# EasyEDA Pro project M0G3507逐飞主板.eprj, schematic Schematic1

## Sheets
1 主控: Board Name: Board1; Create Date: 2025-07-12; Page Name: 主控; Project Name: M0G3507逐飞主板; Schematic Name: Schematic1; Update Date: 2025-07-24; Company: 嘉立创EDA; Page Size: A4; Version: V1.0
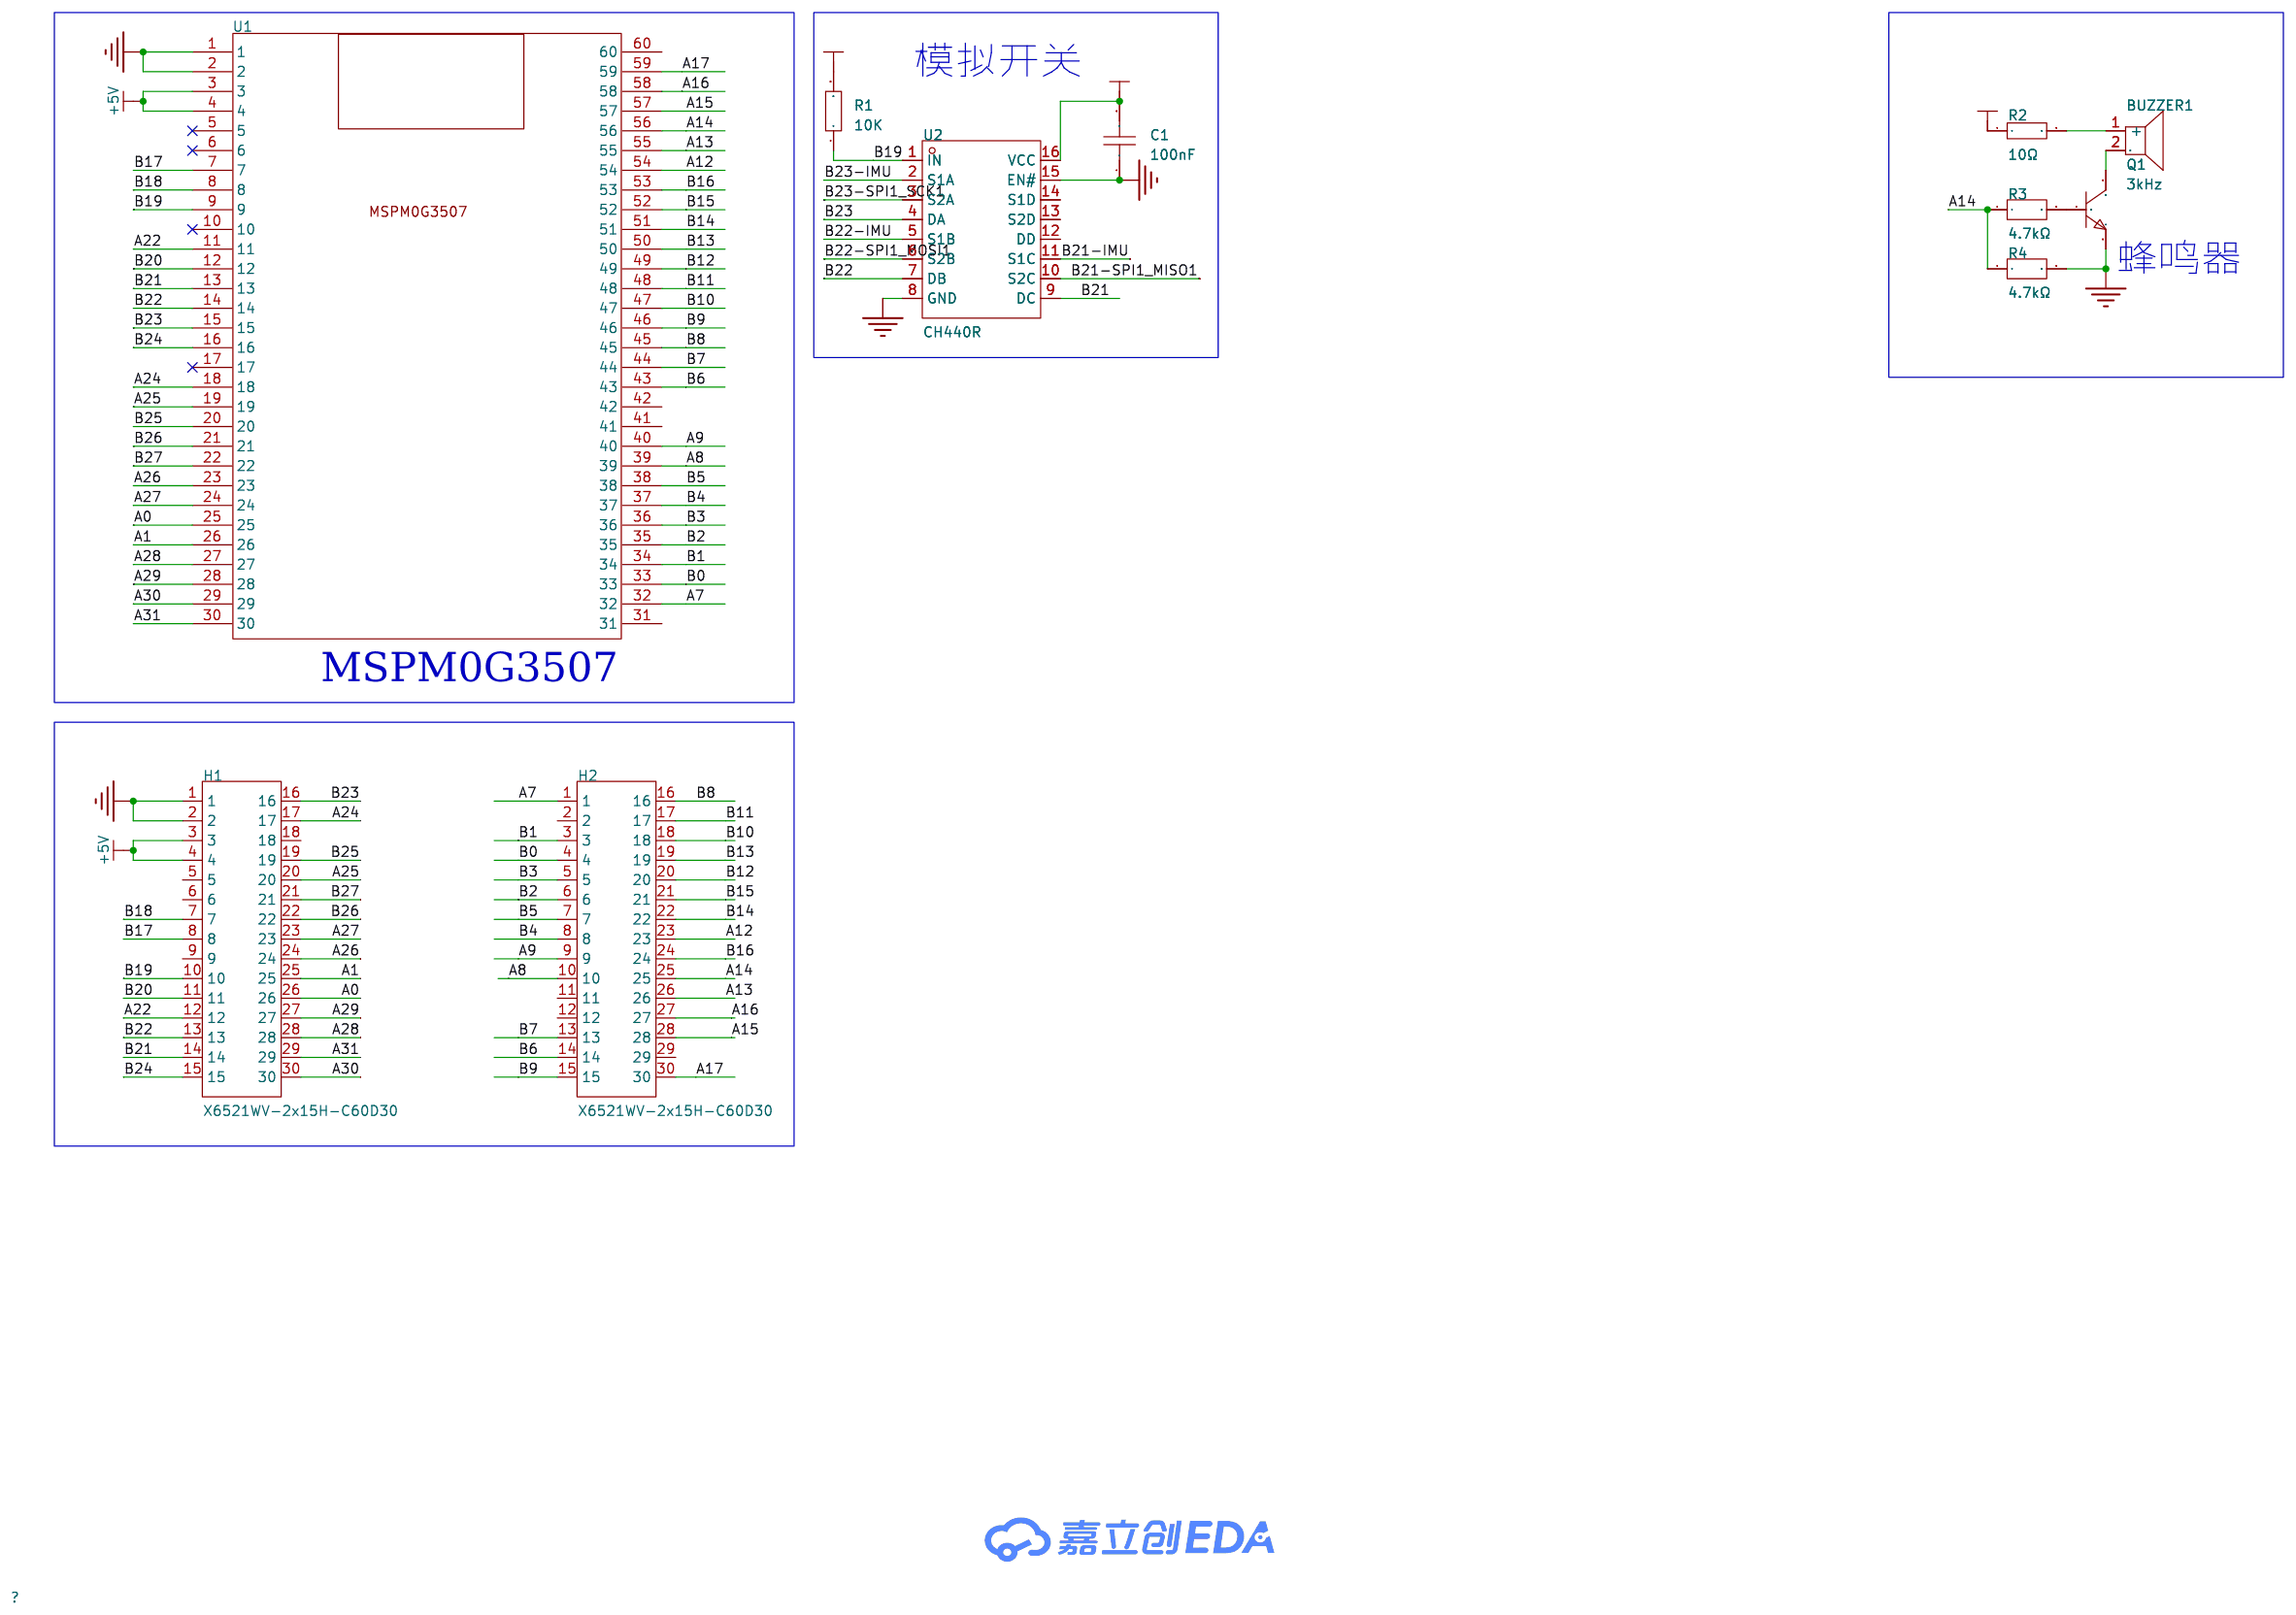
[diagram p0: 主控]
2 电源: Create Date: 2025-07-13; Page Name: 电源
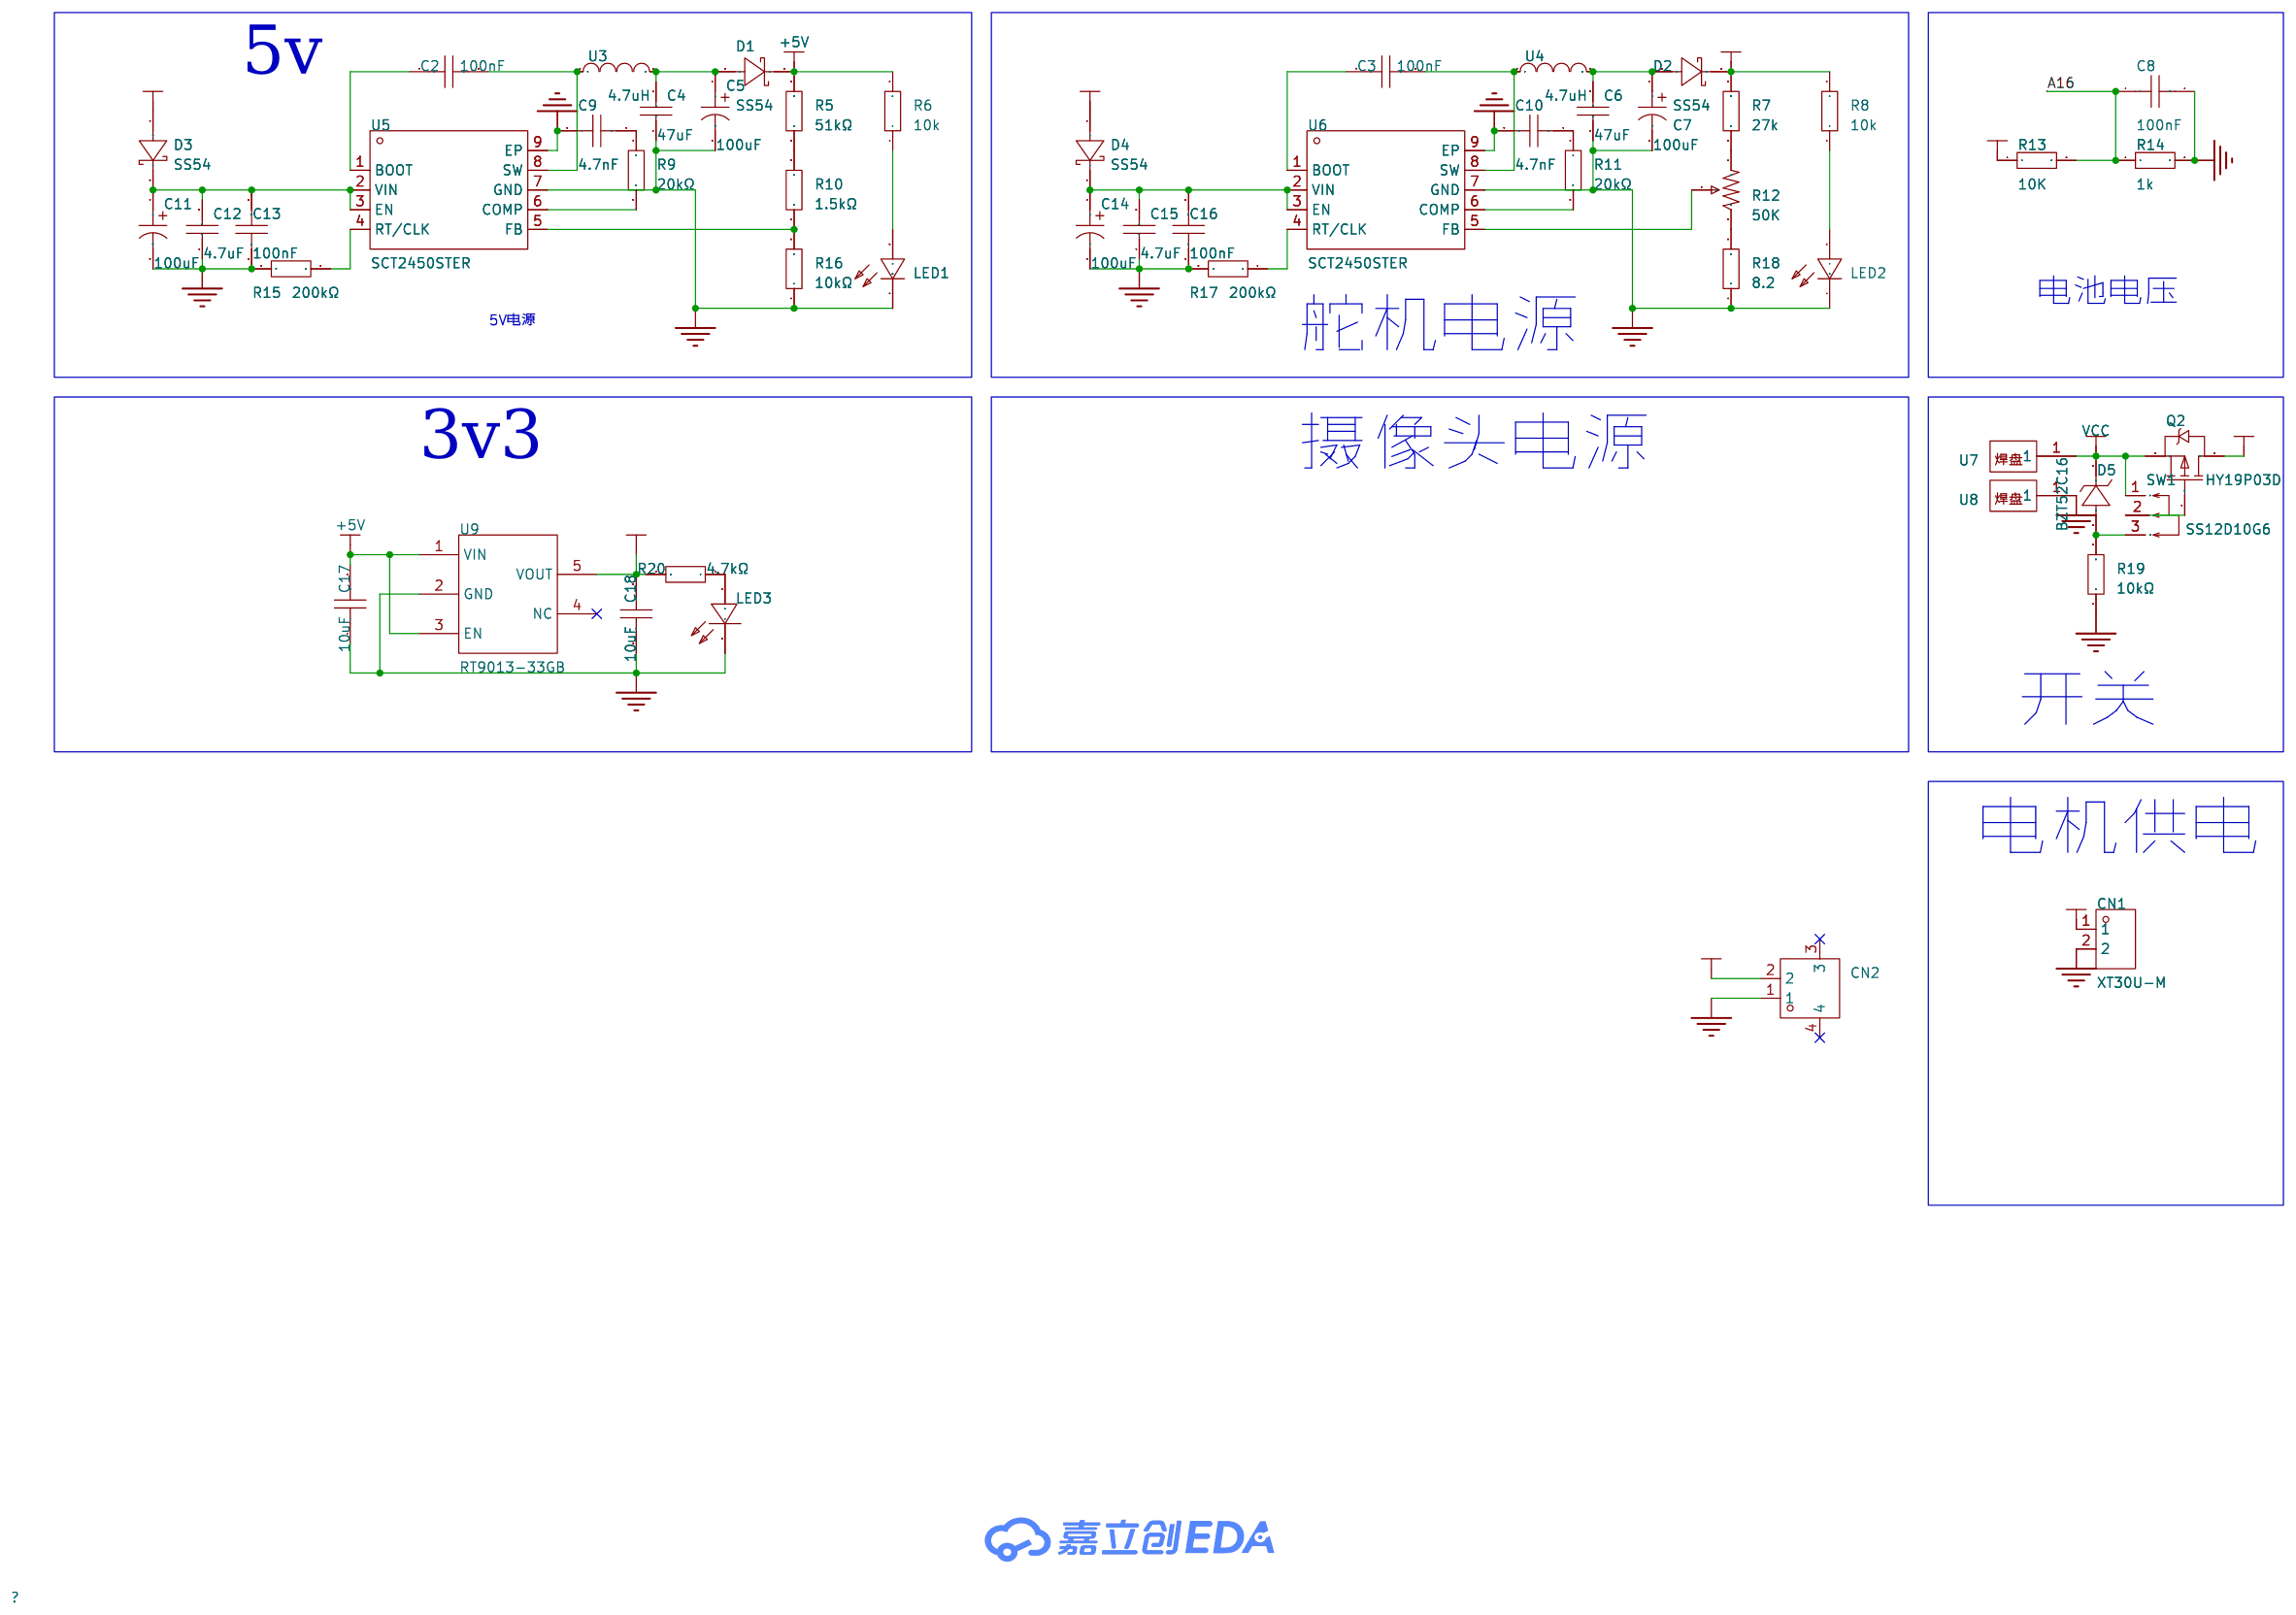
[diagram p1: 电源]
3 外设模块: Create Date: 2025-07-13; Page Name: 外设模块; Update Date: 2025-07-25
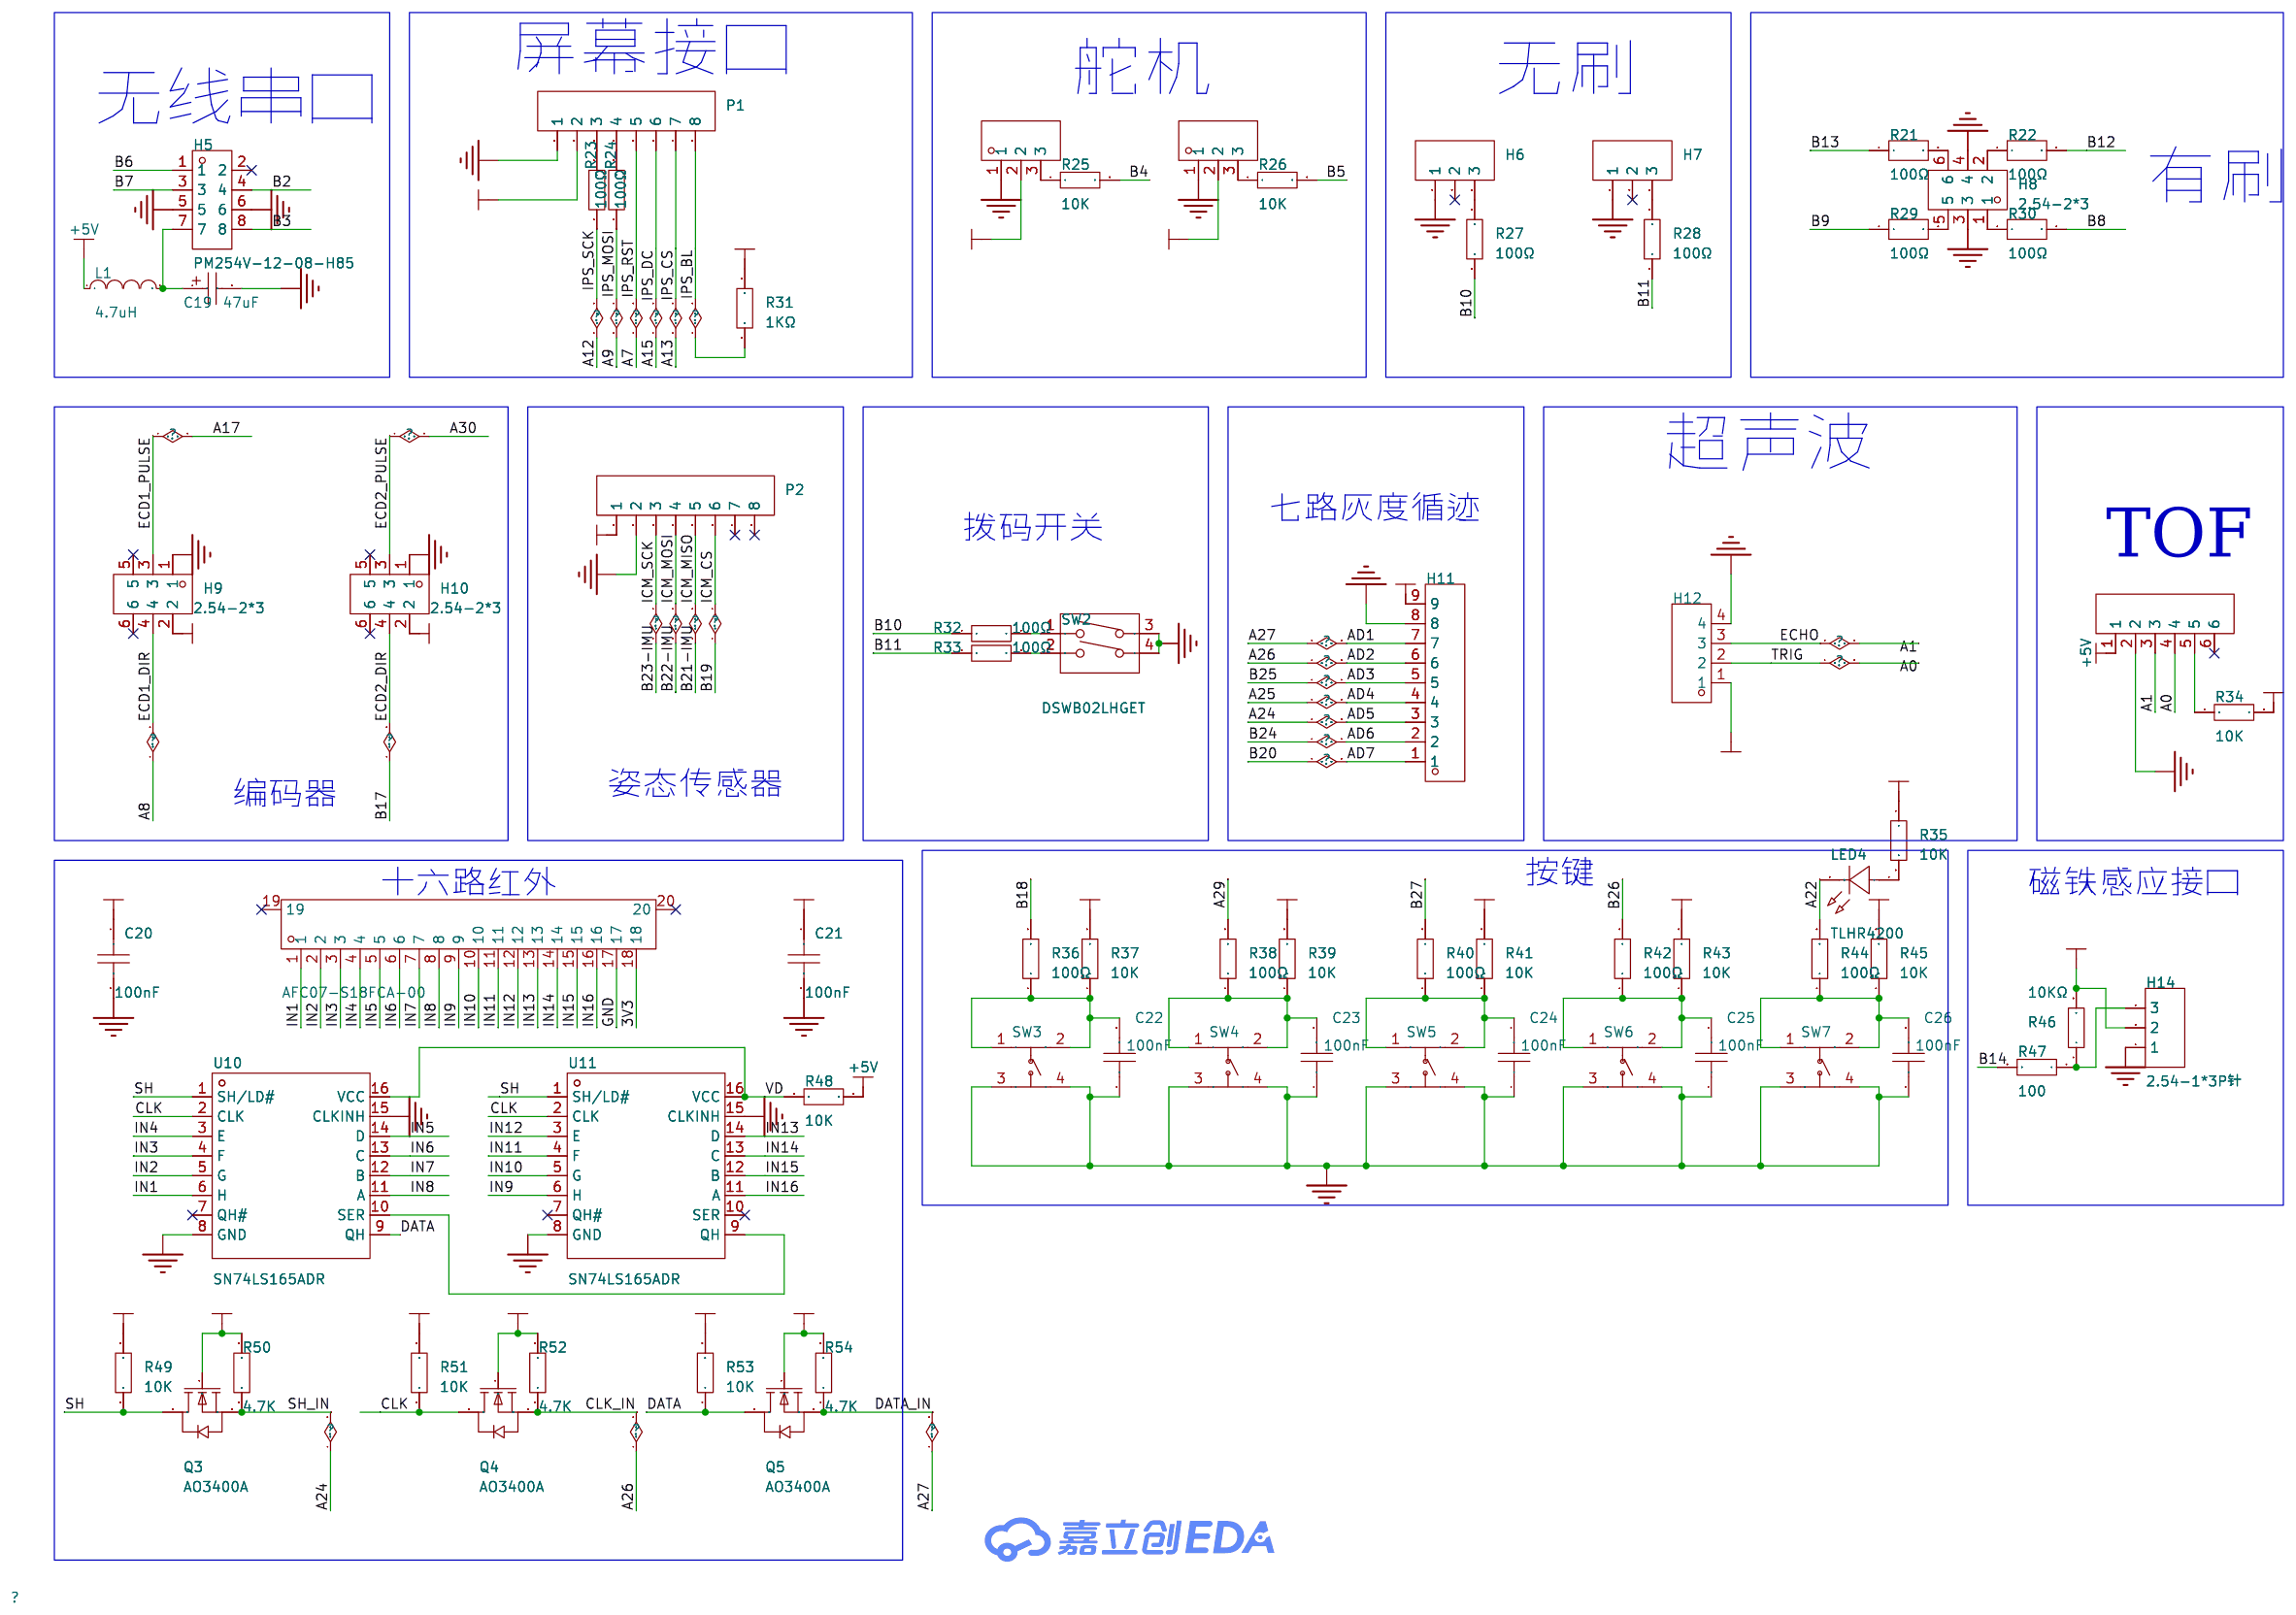
[diagram p2: 外设模块]
4 通信引脚: Create Date: 2025-07-21; Page Name: 通信引脚; Update Date: 2025-07-21
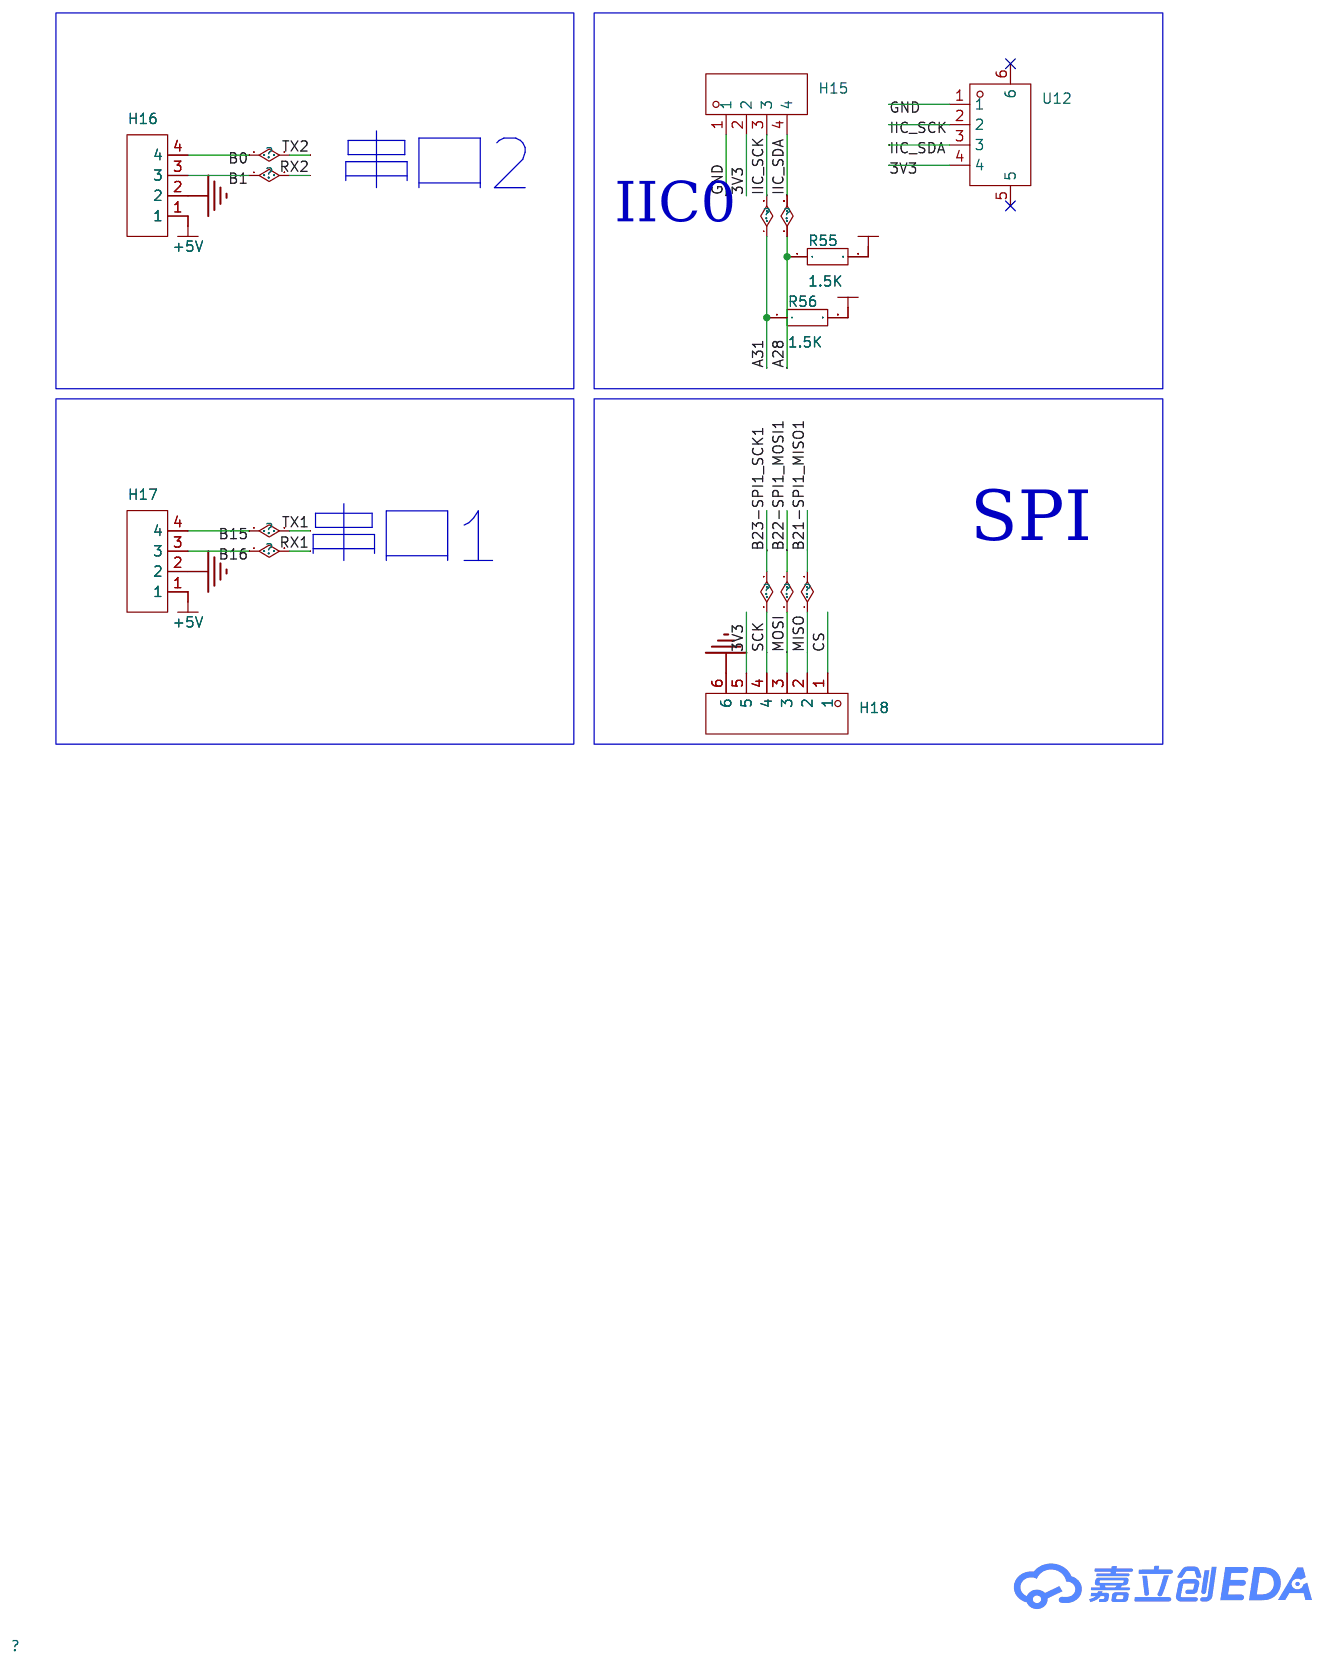
[diagram p3: 通信引脚]

## Parts
sheet 主控
BUZZER1  3kHz  [BUZ-TH_BD9.6-P5.00-D0.7-FD]
C1  100nF  [C0603]
H1  X6521WV-2x15H-C60D30  [HDR-TH_30P-P2.54-V-M-R2-C15-S2.54-BL]
H2  X6521WV-2x15H-C60D30  [HDR-TH_30P-P2.54-V-M-R2-C15-S2.54-BL]
Q1  S8050 J3Y(RANGE:200-350)  [SOT-23-3_L3.0-W1.7-P0.95-LS2.9-BR]
R1  10K  [R0603]
R2  10Ω  [R0603]
R3  4.7kΩ  [R0603]
R4  4.7kΩ  [R0603]
U1  -  [MSPM0G3507]
U2  CH440R  [TSSOP-16_L5.0-W4.4-P0.65-LS6.4-BL]
sheet 外设模块
C19  47uF  [CASE-B_3528]
C20  100nF  [C0402]
C21  100nF  [C0402]
C22  100nF  [C0603]
C23  100nF  [C0603]
C24  100nF  [C0603]
C25  100nF  [C0603]
C26  100nF  [C0603]
H3  -  [HDR-TH_3P-P2.54-V-M]
H4  -  [HDR-TH_3P-P2.54-V-M]
H5  PM254V-12-08-H85  [HDR-TH_8P-P2.54-V-F-R2-C4-S2.54]
H6  2.54-1*3P针  [HDR-TH_3P-P2.54-V-M-1]
H7  2.54-1*3P针  [HDR-TH_3P-P2.54-V-M-1]
H8  2.54-2*3  [HDR-TH_6P-P2.54-V-R2-C3-S2.54_A2541WV-2X3P]
H9  2.54-2*3  [HDR-TH_6P-P2.54-V-R2-C3-S2.54_A2541WV-2X3P]
H10  2.54-2*3  [HDR-TH_6P-P2.54-V-R2-C3-S2.54_A2541WV-2X3P]
H11  HC-PZ254-13.8L-1x9PWA  [HDR-TH_9P-P2.54-H-M-W10.4-N]
H12  -  [HDR-TH_4P-P2.54-V-F]
H13  PZ254V-11-06P  [HDR-TH_6P-P2.54-V-M]
H14  2.54-1*3P针  [HDR-TH_3P-P2.54-V-M-1]
L1  4.7uH  [IND-SMD_L5.4-W5.2_FXL0530]
LED4  TLHR4200  [LED-TH_BD3.2-P2.54-FD]
P1  2.54-1*8P母环保  [HDR-TH_8P-P2.54-V-F-1]
P2  2.54-1*8P母环保  [HDR-TH_8P-P2.54-V-F-1]
Q3  AO3400A  [SOT-23-3_L2.9-W1.3-P1.90-LS2.4-BR]
Q4  AO3400A  [SOT-23-3_L2.9-W1.3-P1.90-LS2.4-BR]
Q5  AO3400A  [SOT-23-3_L2.9-W1.3-P1.90-LS2.4-BR]
R21  100Ω  [R0603]
R22  100Ω  [R0603]
R23  100Ω  [R0603]
R24  100Ω  [R0603]
R25  10K  [R0603]
R26  10K  [R0603]
R27  100Ω  [R0603]
R28  100Ω  [R0603]
R29  100Ω  [R0603]
R30  100Ω  [R0603]
R31  1KΩ  [R0603]
R32  100Ω  [R0603]
R33  100Ω  [R0603]
R34  10K  [R0603]
R35  10K  [R0603]
R36  100Ω  [R0603]
R37  10K  [R0603]
R38  100Ω  [R0603]
R39  10K  [R0603]
R40  100Ω  [R0603]
R41  10K  [R0603]
R42  100Ω  [R0603]
R43  10K  [R0603]
R44  100Ω  [R0603]
R45  10K  [R0603]
R46  10KΩ  [R0603]
R47  100  [R0603]
R48  10K  [R0603]
R49  10K  [R0402]
R50  4.7K  [R0402]
R51  10K  [R0402]
R52  4.7K  [R0402]
R53  10K  [R0402]
R54  4.7K  [R0402]
SW2  DSWB02LHGET  [SW-TH_DSWB02LHGET]
SW3  KH-4.5X4.5X3.8H-STM  [SW-SMD_4P-L4.5-W4.5-P3.00-LS6.8]
SW4  KH-4.5X4.5X3.8H-STM  [SW-SMD_4P-L4.5-W4.5-P3.00-LS6.8]
SW5  KH-4.5X4.5X3.8H-STM  [SW-SMD_4P-L4.5-W4.5-P3.00-LS6.8]
SW6  KH-4.5X4.5X3.8H-STM  [SW-SMD_4P-L4.5-W4.5-P3.00-LS6.8]
SW7  KH-4.5X4.5X3.8H-STM  [SW-SMD_4P-L4.5-W4.5-P3.00-LS6.8]
U10  SN74LS165ADR  [SOIC-16_L9.9-W3.9-P1.27-LS6.0-BL]
U11  SN74LS165ADR  [SOIC-16_L9.9-W3.9-P1.27-LS6.0-BL]
X1  AFC07-S18FCA-00  [FPC-SMD_AFC07-S18FCA-00]
sheet 电源
C2  100nF  [C0603]
C3  100nF  [C0603]
C4  47uF  [C1206]
C5  100uF  [CAP-SMD_BD6.3-L6.6-W6.6-LS7.6-FD-1]
C6  47uF  [C1206]
C7  100uF  [CAP-SMD_BD6.3-L6.6-W6.6-LS7.6-FD-1]
C8  100nF  [C0603]
C9  4.7nF  [C0603]
C10  4.7nF  [C0603]
C11  100uF  [CAP-SMD_BD6.3-L6.6-W6.6-LS7.6-FD-1]
C12  4.7uF  [C1206]
C13  100nF  [C0603]
C14  100uF  [CAP-SMD_BD6.3-L6.6-W6.6-LS7.6-FD-1]